# EasyEDA Pro project Chessboards.epro, board PCB6
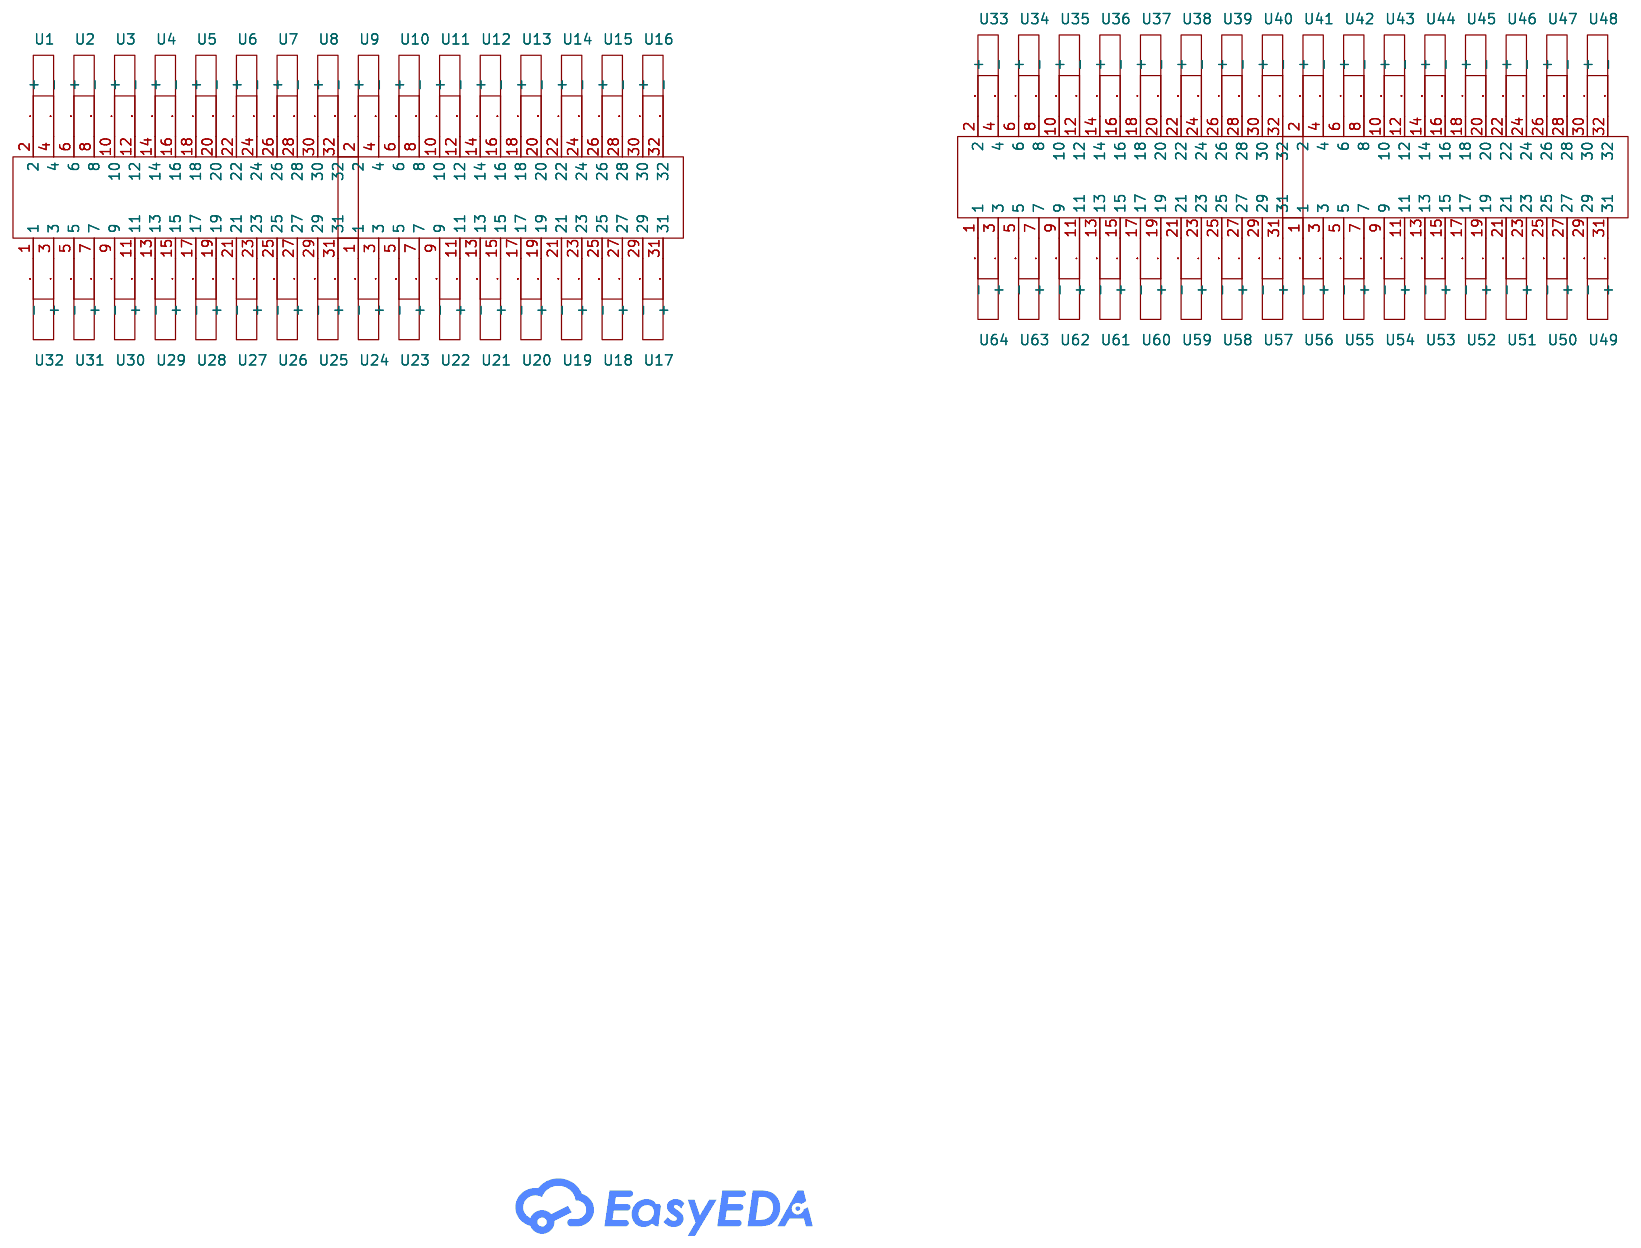
[diagram p0: schematic sheet]

No outline. copper layers: Top Layer, Inner1, Inner2, Inner3, Inner4, Bottom Layer. Coordinates in mm from the lowest, leftmost part position.
Stack: Top Layer 0.035mm Outer layer thickness 1oz / Dielectric1 0.0994mm 3313 RC57% 4.2mil / Inner1 0.0152mm Inner layer thickness / Dielectric2 0.55mm 0.55mm H/H No copper / Inner2 0.0152mm Inner layer thickness / Dielectric3 0.1088mm 2116 RC54% 4.9mil / Inner3 0.0152mm Inner layer thickness / Dielectric4 0.55mm 0.55mm H/H No copper / Inner4 0.0152mm Inner layer thickness / Dielectric5 0.0994mm 3313 RC57% 4.2mil / Bottom Layer 0.035mm Outer layer thickness 1oz

## Design rules (mm)
template: Custom Config
spacing copperThickness1oz (default): track to track 0.102, other pairs 0 to 0.3
spacing copperThickness2oz: track to track 0.203, other pairs 0.152 to 0.3
track width copperThickness1oz (default): min 0.127, default 0.165, max 2.54
track width copperThickness2oz: min 0.127, default 0.165, max 2.54
differential pair differentialPair (default): width min 0.127, default 0.254, max 2.54; gap min 0.152, default 0.152
via viaSize (default): diameter min 0.5, default 0.61, max 10; hole min 0.3, default 0.305, max 6.3

## Placement (name value [footprint] x y rotation side)
H2  BX-PZ1.0-2-16PZZ  [HDR-TH_32P-P1.00-V-M-R2-C16-S1.00]  0 93.01 90 bottom
H3  BX-PZ1.0-2-16PZZ  [HDR-TH_32P-P1.00-V-M-R2-C16-S1.00]  0 132.27 90 bottom
H4  BX-PZ1.0-2-16PZZ  [HDR-TH_32P-P1.00-V-M-R2-C16-S1.00]  0 14.2 90 bottom
H5  BX-PZ1.0-2-16PZZ  [HDR-TH_32P-P1.00-V-M-R2-C16-S1.00]  0 53.61 90 bottom
U1  -  [coil2]  29.62 78.82 0 top
U2  -  [coil2]  49.33 78.82 0 top
U3  -  [coil2]  69.05 78.82 0 top
U4  -  [coil2]  88.77 78.82 0 top
U5  -  [coil2]  108.49 78.82 0 top
U6  -  [coil2]  128.21 78.82 0 top
U7  -  [coil2]  147.93 78.82 0 top
U8  -  [coil2]  167.64 78.82 0 top
U9  -  [coil2]  29.62 118.05 0 top
U10  -  [coil2]  49.33 118.05 0 top
U11  -  [coil2]  69.05 118.05 0 top
U12  -  [coil2]  88.77 118.05 0 top
U13  -  [coil2]  108.49 118.05 0 top
U14  -  [coil2]  128.21 118.05 0 top
U15  -  [coil2]  147.93 118.05 0 top
U16  -  [coil2]  167.64 118.05 0 top
U17  -  [coil2]  29.62 137.78 0 top
U18  -  [coil2]  49.33 137.78 0 top
U19  -  [coil2]  69.05 137.78 0 top
U20  -  [coil2]  88.77 137.78 0 top
U21  -  [coil2]  108.49 137.78 0 top
U22  -  [coil2]  128.21 137.78 0 top
U23  -  [coil2]  147.93 137.78 0 top
U24  -  [coil2]  167.64 137.78 0 top
U25  -  [coil2]  29.62 98.52 0 top
U26  -  [coil2]  49.33 98.52 0 top
U27  -  [coil2]  69.05 98.52 0 top
U28  -  [coil2]  88.77 98.52 0 top
U29  -  [coil2]  108.49 98.52 0 top
U30  -  [coil2]  128.21 98.52 0 top
U31  -  [coil2]  147.93 98.52 0 top
U32  -  [coil2]  167.64 98.52 0 top
U33  -  [coil2]  29.62 0 0 top
U34  -  [coil2]  49.33 0 0 top
U35  -  [coil2]  69.05 0 0 top
U36  -  [coil2]  88.77 0 0 top
U37  -  [coil2]  108.49 0 0 top
U38  -  [coil2]  128.21 0 0 top
U39  -  [coil2]  147.93 0 0 top
U40  -  [coil2]  167.64 0 0 top
U41  -  [coil2]  29.62 39.41 0 top
U42  -  [coil2]  49.33 39.41 0 top
U43  -  [coil2]  69.05 39.41 0 top
U44  -  [coil2]  88.77 39.41 0 top
U45  -  [coil2]  108.49 39.41 0 top
U46  -  [coil2]  128.21 39.41 0 top
U47  -  [coil2]  147.93 39.41 0 top
U48  -  [coil2]  167.64 39.41 0 top
U49  -  [coil2]  29.62 59.11 0 top
U50  -  [coil2]  49.33 59.11 0 top
U51  -  [coil2]  69.05 59.11 0 top
U52  -  [coil2]  88.77 59.11 0 top
U53  -  [coil2]  108.49 59.11 0 top
U54  -  [coil2]  128.21 59.11 0 top
U55  -  [coil2]  147.93 59.11 0 top
U56  -  [coil2]  167.64 59.11 0 top
U57  -  [coil2]  29.62 19.7 0 top
U58  -  [coil2]  49.33 19.7 0 top
U59  -  [coil2]  69.05 19.7 0 top
U60  -  [coil2]  88.77 19.7 0 top
U61  -  [coil2]  108.49 19.7 0 top
U62  -  [coil2]  128.21 19.7 0 top
U63  -  [coil2]  147.93 19.7 0 top
U64  -  [coil2]  167.64 19.7 0 top

## Footprints (pads in the part's own frame, mm; a bottom-side part is the same pattern mirrored in y, then rotated)
coil2
  custom 0x0 smd: 1(-8.716,9.355)
  custom 0x0 smd far side: 2(-9.217,8.956)
HDR-TH_32P-P1.00-V-M-R2-C16-S1.00
  rect 0.8x0.8 hole 0.5: 1(-7.5,-0.5)
  round 0.8 hole 0.5: 2(-7.5,0.5) 3(-6.5,-0.5) 4(-6.5,0.5) 5(-5.5,-0.5) 6(-5.5,0.5) 7(-4.5,-0.5) 8(-4.5,0.5) 9(-3.5,-0.5) 10(-3.5,0.5) 11(-2.5,-0.5) 12(-2.5,0.5) 13(-1.5,-0.5) 14(-1.5,0.5) 15(-0.5,-0.5) 16(-0.5,0.5) 17(0.5,-0.5) 18(0.5,0.5) 19(1.5,-0.5) 20(1.5,0.5) 21(2.5,-0.5) 22(2.5,0.5) 23(3.5,-0.5) 24(3.5,0.5) 25(4.5,-0.5) 26(4.5,0.5) 27(5.5,-0.5) 28(5.5,0.5) 29(6.5,-0.5) 30(6.5,0.5) 31(7.5,-0.5) 32(7.5,0.5)

## Nets
As in the schematic.

## Via types
v1: diameter 0.61, hole 0.305, Top Layer to Bottom Layer, 92 vias

## Routing (per net, layer and track width the routed paths; a pad name or vN(x,y) marks a point on that pad's centre or on a via; arc(x,y) is an arc through that point)
$1N10438: length 22.8
  Top Layer w0.165: 20.83,88.16 20.67,88.32 19.63,88.32 18.92,87.6 v1(18.92,85.57)
  Bottom Layer w0.165: v1(18.92,85.57) 18.86,85.51 0.47,85.51
$1N10440: length 20.7
  Bottom Layer w0.165: 0.47,86.51 18.98,86.51 19.56,87.1 19.56,87.5 19.81,87.76 20.42,87.76
$1N10442: length 43.1
  Top Layer w0.165: 40.59,88.17 39.61,88.17 39.24,87.8 v1(39.24,86.83)
  Bottom Layer w0.165: v1(39.24,86.83) 39.24,87.73 38.41,88.55 22.5,88.55 22.24,88.81 18.09,88.81 16.8,87.51 0.47,87.51
$1N10444: length 40.8
  Bottom Layer w0.165: 40.09,87.77 38.79,89.08 16.21,89.08 15.19,88.05 0.93,88.05 0.47,88.51
$1N10446: length 62.7
  Top Layer w0.165: v1(58.71,86.55) 58.71,87.35 59.53,88.17 60.31,88.17
  Bottom Layer w0.165: v1(58.71,86.55) 58.71,87.38 57.77,88.33 42.49,88.33 41.47,89.34 0.65,89.34 0.47,89.51
$1N10448: length 60.5
  Bottom Layer w0.165: 0.47,90.51 1.38,89.61 41.91,89.61 42.92,88.59 58.99,88.59 59.81,87.77
$1N10450: length 80.9
  Top Layer w0.165: 80.03,88.17 78.67,88.17 77.99,88.85 4.81,88.85 2.15,91.51 0.47,91.51
$1N10452: length 81
  Bottom Layer w0.165: 0.47,92.51 1.99,91 15.64,91 16.76,89.88 42.02,89.88 42.27,89.63 77.67,89.63 79.53,87.77
$1N10454: length 105.1
  Top Layer w0.165: v1(98.62,86.78) 98.62,87.4 99.39,88.17 99.75,88.17
  Inner1 w0.165: v1(98.62,86.78) 98.62,87.53 97.83,88.32 81.97,88.32 81.39,88.89 78.94,88.89 78.31,88.27 61.92,88.27 61.31,88.88 59.44,88.88 58.74,88.18 42.74,88.18 41.99,88.93 40.61,88.93 39.99,88.3 22.36,88.3 21.79,88.88 19.11,88.88 14.47,93.51 0.47,93.51
$1N10456: length 103.9
  Inner2 w0.165: 0.47,94.51 1.01,93.98 13.94,93.98 19.06,88.85 21.94,88.85 22.44,88.35 40.14,88.35 40.64,88.85 41.99,88.85 42.71,88.13 58.69,88.13 58.86,88.3 58.86,88.3 59.44,88.88 61.36,88.88 61.99,88.25 79.17,88.25 79.97,89.06 81.21,89.06 81.95,88.32 97.18,88.32 97.84,87.65 v1(97.84,87.3)
  Bottom Layer w0.165: 99.25,87.77 98.31,87.77 v1(97.84,87.3)
$1N10458: length 124.6
  Top Layer w0.165: v1(117.54,86.78) 117.54,87.53 118.19,88.17 119.47,88.17
  Inner2 w0.165: v1(117.54,86.78) 117.54,87.85 117.24,88.15 101.72,88.15 100.86,89.01 99.02,89.01 98.6,88.58 82.06,88.58 81.32,89.33 19.08,89.33 13.13,95.28 0.71,95.28 0.47,95.51
$1N10460: length 125
  Inner1 w0.165: v1(118.34,86.5) 118.27,86.58 118.27,87.58 117.69,88.15 101.67,88.15 100.86,88.96 99,88.96 98.62,88.58 82.08,88.58 81.51,89.16 78.83,89.16 78.2,88.53 62.03,88.53 61.37,89.19 19.17,89.19 11.85,96.51 0.47,96.51
  Bottom Layer w0.165: 118.96,87.77 118.8,87.61 118.79,87.61 118.5,87.32 118.5,87.31 118.34,87.15 v1(118.34,86.5)
$1N10462: length 146.1
  Top Layer w0.165: v1(137.42,86.25) 137.42,87.65 137.94,88.17 139.18,88.17
  Inner2 w0.165: 0.47,97.51 11.27,97.51 19.2,89.59 81.45,89.59 82.19,88.85 98.35,88.85 98.77,89.28 116.65,89.28 117,88.93 120.57,88.93 121.49,88 137.02,88 137.42,87.6 v1(137.42,86.25)
$1N10464: length 147.2
  Inner1 w0.165: v1(138.19,86.08) 138.07,86.2 138.07,87.84 137.9,88 121.44,88 120.54,88.9 117.99,88.9 117.5,88.42 102.05,88.42 101.24,89.23 98.83,89.23 98.46,88.85 82.19,88.85 81.62,89.43 78.72,89.43 78.09,88.8 62.14,88.8 61.48,89.46 19.28,89.46 11.96,96.78 3.26,96.78 1.53,98.51 0.47,98.51
  Bottom Layer w0.165: v1(138.19,86.08) 138.07,86.2 138.07,87.38 138.46,87.77 138.68,87.77
$1N10466: length 165.8
  Top Layer w0.165: 158.9,88.17 157.64,88.17 157.04,87.58 v1(157.04,86.8)
  Inner2 w0.165: v1(157.04,86.8) 157.04,88.73 155.91,89.86 19.31,89.86 9.65,99.51 0.47,99.51
$1N10468: length 166.3
  Inner1 w0.165: 0.47,100.51 H2.32 3.76,97.25 11.86,97.25 19.39,89.73 138.54,89.73 139.14,89.13 156.59,89.13 157.89,87.83 v1(157.89,86.18)
  Bottom Layer w0.165: 158.4,87.77 158.14,87.77 157.89,87.53 v1(157.89,86.18)
$1N10470: length 28.3
  Top Layer w0.165: 20.85,107.9 20.73,108.03 19.81,108.03 19.02,107.24 v1(19.02,101.75)
  Bottom Layer w0.165: -0.53,100.51 -0.51,100.53 -0.51,101.5 -0.39,101.62 18.89,101.62 v1(19.02,101.75)
$1N10472: length 29.6
  Top Layer w0.165: v1(18.41,107.47) 18.41,102.46 v1(18.39,102.44)
  Bottom Layer w0.165: -0.53,99.51 -0.64,99.63 -1.1,99.63 -1.22,99.75 -1.22,101.55 -0.33,102.44 v1(18.39,102.44) ; v1(18.41,107.47) 18.42,107.48 U25.2 20.42,107.48
$1N10474: length 54.1
  Top Layer w0.165: 40.59,107.88 39.71,107.88 38.71,106.88 v1(38.71,105.9)
  Bottom Layer w0.165: -0.53,98.51 -1.59,99.58 -1.59,101.9 -0.31,103.18 16.89,103.18 17.79,104.08 17.79,107.65 18.62,108.48 22.34,108.48 22.92,107.9 38.04,107.9 38.71,107.23 v1(38.71,105.9)
$1N10476: length 52.4
  Bottom Layer w0.165: 40.09,107.48 39.4,108.17 23.03,108.17 22.45,108.75 18.51,108.75 17.52,107.76 17.52,104.19 16.78,103.44 -0.42,103.44 -1.86,102.01 -1.86,98.84 -0.53,97.51
$1N10478: length 74.1
  Top Layer w0.165: 60.31,107.88 59.44,107.88 58.77,107.2 v1(58.77,106.38)
  Bottom Layer w0.165: v1(58.77,106.38) 58.77,107 57.33,108.44 23.14,108.44 22.56,109.02 4.77,109.02 -2.12,102.12 -2.12,98.11 -0.53,96.51
$1N10480: length 73.4
  Bottom Layer w0.165: -0.53,95.51 -2.39,97.38 -2.39,102.23 4.66,109.29 22.67,109.29 23.25,108.7 58.58,108.7 59.81,107.48
$1N10482: length 95.3
  Top Layer w0.165: v1(78.49,108.02) 79.03,108.02 79.24,108.23 79.68,108.23 80.03,107.88
  Bottom Layer w0.165: -0.53,94.51 -2.66,96.65 -2.66,102.35 4.55,109.55 22.78,109.55 23.36,108.97 77.54,108.97 v1(78.49,108.02)
$1N10484: length 94.6
  Inner1 w0.165: -0.53,93.51 -0.86,93.51 -1.65,94.3 -1.65,101.46 5.43,108.54 77.43,108.54 77.89,108.09 77.89,106.98 v1(78.29,106.58)
  Bottom Layer w0.165: v1(78.29,106.58) 79.19,107.48 79.53,107.48
$1N10486: length 117.6
  Top Layer w0.165: 99.75,107.88 99.46,108.16 99.03,108.16 98.65,107.78 98.65,106.13 98.27,105.75 97.79,105.75 97.57,105.98 97.57,107.83 96.83,108.56 5.62,108.56 -1.24,101.7 -1.24,93.23 -0.53,92.51
$1N10488: length 116.7
  Top Layer w0.165: v1(98.11,106.48) 98.11,107.66 96.94,108.83 5.51,108.83 -1.5,101.81 -1.5,92.6 -0.53,91.62 -0.53,91.51
  Bottom Layer w0.165: 99.25,107.48 98.62,107.48 98.11,106.97 v1(98.11,106.48)
$1N10490: length 140.7
  Top Layer w0.165: 119.47,107.88 119.31,108.03 118.84,108.03 118.41,107.6 118.41,105.87 118.24,105.7 117.64,105.7 117.33,106.01 117.33,107.91 116.15,109.09 5.4,109.09 -1.77,101.92 -1.77,91.76 -0.53,90.51
$1N10492: length 139.8
  Top Layer w0.165: v1(117.87,106.57) 117.87,107.75 116.26,109.36 5.29,109.36 -2.04,102.03 -2.04,91.03 -0.53,89.51
  Bottom Layer w0.165: 118.96,107.48 118.54,107.48 117.69,106.63 117.82,106.63 v1(117.87,106.57)
$1N10494: length 159.7
  Top Layer w0.165: 139.18,107.88 138.71,108.35 136.64,108.35 135.37,109.63 5.18,109.63 -2.31,102.15 -2.31,91.81 -2.31,91.8 -2.31,90.3 -0.53,88.51
$1N10496: length 158.8
  Inner1 w0.165: -0.53,87.51 -1.91,88.9 -1.91,101.57 5.32,108.81 136.56,108.81 v1(137.71,107.66)
  Bottom Layer w0.165: v1(137.71,107.66) 138.5,107.66 138.68,107.48
$1N10498: length 180.5
  Top Layer w0.165: 158.9,107.88 158.65,108.13 v1(155.42,108.13)
  Inner1 w0.165: -0.53,86.51 -2.18,88.17 -2.18,101.69 5.21,109.08 139.89,109.08 140.84,108.13 v1(155.42,108.13)
$1N10500: length 182.1
  Inner1 w0.165: v1(157.19,108.73) 156.54,109.38 4.79,109.38 -2.45,102.14 -2.45,87.44 -0.53,85.51
  Bottom Layer w0.165: v1(157.19,108.73) 158.4,107.52 158.4,107.48
$1N10638: length 22.8
  Top Layer w0.165: 20.83,127.42 20.67,127.57 19.63,127.57 18.92,126.86 v1(18.92,124.83)
  Bottom Layer w0.165: 0.47,124.77 18.86,124.77 v1(18.92,124.83)
$1N10640: length 20.7
  Bottom Layer w0.165: 0.47,125.77 18.98,125.77 19.56,126.35 19.56,126.76 19.81,127.01 20.42,127.01
$1N10642: length 43.1
  Top Layer w0.165: 40.59,127.43 39.61,127.43 39.24,127.06 v1(39.24,126.08)
  Bottom Layer w0.165: v1(39.24,126.08) 39.24,126.98 38.41,127.81 22.5,127.81 22.24,128.06 18.09,128.06 16.8,126.77 0.47,126.77
$1N10644: length 40.8
  Bottom Layer w0.165: 0.47,127.77 0.93,127.31 15.19,127.31 16.21,128.33 38.79,128.33 40.09,127.03
$1N10646: length 62.7
  Top Layer w0.165: 60.31,127.43 59.53,127.43 58.71,126.61 v1(58.71,125.81)
  Bottom Layer w0.165: v1(58.71,125.81) 58.71,126.63 57.77,127.58 42.49,127.58 41.47,128.6 0.65,128.6 0.47,128.77
$1N10648: length 60.5
  Bottom Layer w0.165: 59.81,127.03 58.99,127.85 42.92,127.85 41.91,128.87 1.38,128.87 0.47,129.77
$1N10650: length 80.9
  Top Layer w0.165: 0.47,130.77 2.15,130.77 4.81,128.11 77.99,128.11 78.67,127.43 80.03,127.43
$1N10652: length 81
  Bottom Layer w0.165: 79.53,127.03 77.67,128.88 42.27,128.88 42.02,129.13 16.76,129.13 15.64,130.26 1.99,130.26 0.47,131.77
$1N10654: length 105.1
  Top Layer w0.165: v1(98.62,126.03) 98.62,126.66 99.39,127.43 99.75,127.43
  Inner1 w0.165: 0.47,132.77 14.47,132.77 19.11,128.13 21.79,128.13 22.36,127.56 39.99,127.56 40.61,128.18 41.99,128.18 42.74,127.43 58.74,127.43 59.44,128.13 61.31,128.13 61.92,127.52 78.31,127.52 78.94,128.15 81.39,128.15 81.97,127.57 97.83,127.57 98.62,126.78 v1(98.62,126.03)
$1N10656: length 103.9
  Inner2 w0.165: v1(97.84,126.56) 97.84,126.91 97.18,127.57 81.95,127.57 81.21,128.31 79.97,128.31 79.17,127.51 61.99,127.51 61.36,128.13 59.44,128.13 58.86,127.55 58.86,127.55 58.69,127.39 42.71,127.39 41.99,128.11 40.64,128.11 40.14,127.61 22.44,127.61 21.94,128.11 19.06,128.11 13.94,133.23 1.01,133.23 0.47,133.77
  Bottom Layer w0.165: v1(97.84,126.56) 98.31,127.03 99.25,127.03
$1N10658: length 124.6
  Top Layer w0.165: v1(117.54,126.03) 117.54,126.78 118.19,127.43 119.47,127.43
  Inner2 w0.165: v1(117.54,126.03) 117.54,127.11 117.24,127.41 101.72,127.41 100.86,128.27 99.02,128.27 98.6,127.84 82.06,127.84 81.32,128.58 19.08,128.58 13.13,134.53 0.71,134.53 0.47,134.77
$1N10660: length 125
  Inner1 w0.165: 0.47,135.77 11.85,135.77 19.17,128.45 61.37,128.45 62.03,127.79 78.2,127.79 78.83,128.42 81.51,128.42 82.08,127.84 98.62,127.84 99,128.22 100.86,128.22 101.67,127.41 117.69,127.41 118.27,126.83 118.27,125.83 v1(118.34,125.76)
  Bottom Layer w0.165: v1(118.34,125.76) 118.34,126.41 118.5,126.57 118.5,126.58 118.79,126.87 118.8,126.87 118.96,127.03
$1N10662: length 146.1
  Top Layer w0.165: 139.18,127.43 137.94,127.43 137.42,126.91 v1(137.42,125.51)
  Inner2 w0.165: 0.47,136.77 11.27,136.77 19.2,128.85 81.45,128.85 82.19,128.11 98.35,128.11 98.77,128.53 116.65,128.53 117,128.18 120.57,128.18 121.49,127.26 137.02,127.26 137.42,126.86 v1(137.42,125.51)
$1N10664: length 147.2
  Inner1 w0.165: v1(138.19,125.33) 138.07,125.46 138.07,127.09 137.9,127.26 121.44,127.26 120.54,128.16 117.99,128.16 117.5,127.67 102.05,127.67 101.24,128.48 98.83,128.48 98.46,128.11 82.19,128.11 81.62,128.68 78.72,128.68 78.09,128.06 62.14,128.06 61.48,128.72 19.28,128.72 11.96,136.04 3.26,136.04 1.53,137.77 0.47,137.77
  Bottom Layer w0.165: v1(138.19,125.33) 138.07,125.46 138.07,126.63 138.46,127.03 138.68,127.03
$1N10666: length 165.8
  Top Layer w0.165: 158.9,127.43 157.64,127.43 157.04,126.83 v1(157.04,126.06)
  Inner2 w0.165: v1(157.04,126.06) 157.04,127.98 155.91,129.12 19.31,129.12 9.65,138.77 0.47,138.77
$1N10668: length 166.3
  Inner1 w0.165: 0.47,139.77 H3.32 3.76,136.51 11.86,136.51 19.39,128.98 138.54,128.98 139.14,128.38 156.59,128.38 157.89,127.08 v1(157.89,125.43)
  Bottom Layer w0.165: 158.4,127.03 158.14,127.03 157.89,126.78 v1(157.89,125.43)
$1N10670: length 28.3
  Top Layer w0.165: v1(19.02,141.01) 19.02,146.49 19.81,147.28 20.73,147.28 20.85,147.15
  Bottom Layer w0.165: v1(19.02,141.01) 18.89,140.87 -0.39,140.87 -0.51,140.75 -0.51,139.79 -0.53,139.77
$1N10672: length 29.6
  Top Layer w0.165: v1(18.39,141.69) 18.41,141.72 v1(18.41,146.72)
  Bottom Layer w0.165: v1(18.41,146.72) 18.42,146.73 20.37,146.73 ; v1(18.39,141.69) -0.33,141.69 -1.22,140.81 -1.22,139 -1.1,138.88 -0.64,138.88 -0.53,138.77
$1N10674: length 54.1
  Top Layer w0.165: 40.59,147.13 39.71,147.13 38.71,146.13 v1(38.71,145.16)
  Bottom Layer w0.165: v1(38.71,145.16) 38.71,146.48 38.04,147.16 22.92,147.16 22.34,147.74 18.62,147.74 17.79,146.91 17.79,143.33 16.89,142.43 -0.31,142.43 -1.59,141.16 -1.59,138.83 -0.53,137.77
$1N10676: length 52.4
  Bottom Layer w0.165: -0.53,136.77 -1.86,138.1 -1.86,141.27 -0.42,142.7 16.78,142.7 17.52,143.44 17.52,147.02 18.51,148.01 22.45,148.01 23.03,147.43 39.4,147.43 40.09,146.73
$1N10678: length 74.1
  Top Layer w0.165: v1(58.77,145.63) 58.77,146.46 59.44,147.13 60.31,147.13
  Bottom Layer w0.165: -0.53,135.77 -2.12,137.37 -2.12,141.38 4.77,148.27 22.56,148.27 23.14,147.69 57.33,147.69 58.77,146.26 v1(58.77,145.63)
$1N10680: length 73.4
  Bottom Layer w0.165: -0.53,134.77 -2.39,136.63 -2.39,141.49 4.66,148.54 22.67,148.54 23.25,147.96 58.58,147.96 59.81,146.73
$1N10682: length 95.3
  Top Layer w0.165: 80.03,147.13 79.68,147.48 79.24,147.48 79.03,147.28 v1(78.49,147.28)
  Bottom Layer w0.165: -0.53,133.77 -2.66,135.9 -2.66,141.6 4.55,148.81 22.78,148.81 23.36,148.23 77.54,148.23 v1(78.49,147.28)
$1N10684: length 94.6
  Inner1 w0.165: v1(78.29,145.83) 77.89,146.23 77.89,147.34 77.43,147.8 5.43,147.8 -1.65,140.72 -1.65,133.56 -0.86,132.77 -0.53,132.77
  Bottom Layer w0.165: 79.53,146.73 79.19,146.73 v1(78.29,145.83)
$1N10686: length 117.6
  Top Layer w0.165: 99.75,147.13 99.46,147.42 99.03,147.42 98.65,147.04 98.65,145.39 98.27,145.01 97.79,145.01 97.57,145.23 97.57,147.08 96.83,147.82 5.62,147.82 -1.24,140.96 -1.24,132.48 -0.53,131.77
$1N10688: length 116.7
  Top Layer w0.165: v1(98.11,145.73) 98.11,146.92 96.94,148.08 5.51,148.08 -1.5,141.07 -1.5,131.85 -0.53,130.87 -0.53,130.77
  Bottom Layer w0.165: 99.25,146.73 98.62,146.73 98.11,146.22 v1(98.11,145.73)
$1N10690: length 140.7
  Top Layer w0.165: -0.53,129.77 -1.77,131.02 -1.77,141.18 5.4,148.35 116.15,148.35 117.33,147.17 117.33,145.27 117.64,144.96 118.24,144.96 118.41,145.13 118.41,146.85 118.84,147.28 119.31,147.28 119.47,147.13
$1N10692: length 139.8
  Top Layer w0.165: -0.53,128.77 -2.04,130.28 -2.04,141.29 5.29,148.62 116.26,148.62 117.87,147.01 v1(117.87,145.83)
  Bottom Layer w0.165: 118.96,146.73 118.54,146.73 117.69,145.88 117.82,145.88 v1(117.87,145.83)
$1N10694: length 159.7
  Top Layer w0.165: 139.18,147.13 138.71,147.61 136.64,147.61 135.37,148.88 5.18,148.88 -2.31,141.4 -2.31,131.06 -2.31,131.06 -2.31,129.56 -0.53,127.77
$1N10696: length 158.8
  Inner1 w0.165: v1(137.71,146.92) 136.56,148.07 5.32,148.07 -1.91,140.83 -1.91,128.16 -0.53,126.77
  Bottom Layer w0.165: 138.68,146.73 138.5,146.92 v1(137.71,146.92)
$1N10698: length 180.5
  Top Layer w0.165: 158.9,147.13 158.65,147.38 v1(155.42,147.38)
  Inner1 w0.165: -0.53,125.77 -2.18,127.42 -2.18,140.94 5.21,148.33 139.89,148.33 140.84,147.38 v1(155.42,147.38)
$1N10700: length 182.1
  Inner1 w0.165: v1(157.19,147.98) 156.54,148.63 4.79,148.63 -2.45,141.4 -2.45,126.69 -0.53,124.77
  Bottom Layer w0.165: v1(157.19,147.98) 158.4,146.78 158.4,146.73
$1N10974: length 22.8
  Top Layer w0.165: 20.85,9.35 20.7,9.5 19.66,9.5 18.95,8.79 v1(18.95,6.76)
  Bottom Layer w0.165: v1(18.95,6.76) 18.89,6.7 H4.2
$1N10976: length 20.7
  Bottom Layer w0.165: 20.45,8.94 19.84,8.94 19.58,8.69 19.58,8.28 19,7.7 H4.4
$1N10978: length 43.1
  Top Layer w0.165: v1(39.27,8.01) 39.27,8.99 39.63,9.36 U34.1
  Bottom Layer w0.165: v1(39.27,8.01) 39.27,8.91 38.44,9.74 22.52,9.74 22.27,9.99 18.12,9.99 16.83,8.7 H4.6
$1N10980: length 40.8
  Bottom Layer w0.165: H4.8 0.96,9.24 15.22,9.24 16.24,10.26 38.81,10.26 U34.2
$1N10982: length 105.1
  Top Layer w0.165: U37.1 99.41,9.36 98.64,8.59 v1(98.64,7.96)
  Inner1 w0.165: H4.18 14.49,14.7 19.13,10.06 21.81,10.06 22.39,9.49 40.02,9.49 40.64,10.11 42.02,10.11 42.77,9.36 58.76,9.36 59.46,10.06 61.34,10.06 61.95,9.45 78.34,9.45 78.96,10.08 81.42,10.08 82,9.5 97.85,9.5 98.64,8.71 v1(98.64,7.96)
$1N10984: length 103.9
  Inner2 w0.165: H4.20 1.04,15.16 13.96,15.16 19.09,10.04 21.96,10.04 22.46,9.54 40.17,9.54 40.67,10.04 42.02,10.04 42.74,9.32 58.72,9.32 58.88,9.48 58.89,9.48 59.47,10.06 61.39,10.06 62.02,9.44 79.19,9.44 80,10.24 81.23,10.24 81.97,9.5 97.2,9.5 97.87,8.84 v1(97.87,8.49)
  Bottom Layer w0.165: v1(97.87,8.49) 98.34,8.96 U37.2
$1N10986: length 43.1
  Top Layer w0.165: v1(39.24,47.42) 39.24,48.39 39.61,48.76 40.59,48.76
  Bottom Layer w0.165: v1(39.24,47.42) 39.24,48.32 38.41,49.14 22.5,49.14 22.24,49.4 18.09,49.4 16.8,48.11 0.47,48.11
$1N10988: length 40.8
  Bottom Layer w0.165: 40.09,48.36 38.79,49.67 16.21,49.67 15.19,48.65 0.93,48.65 0.47,49.11
$1N10990: length 62.7
  Top Layer w0.165: 60.31,48.76 59.53,48.76 58.71,47.94 v1(58.71,47.14)
  Bottom Layer w0.165: 0.47,50.11 0.65,49.94 41.47,49.94 42.49,48.92 57.77,48.92 58.71,47.97 v1(58.71,47.14)
$1N10992: length 60.5
  Bottom Layer w0.165: 59.81,48.36 58.99,49.19 42.92,49.19 41.91,50.2 1.38,50.2 0.47,51.11
$1N10994: length 124.6
  Top Layer w0.165: 119.47,48.76 118.19,48.76 117.54,48.12 v1(117.54,47.37)
  Inner2 w0.165: v1(117.54,47.37) 117.54,48.44 117.24,48.74 101.72,48.74 100.86,49.6 99.02,49.6 98.6,49.18 82.06,49.18 81.32,49.92 19.08,49.92 13.13,55.87 0.71,55.87 0.47,56.11
$1N10996: length 125
  Inner1 w0.165: 0.47,57.11 11.85,57.11 19.17,49.79 61.37,49.79 62.03,49.13 78.2,49.13 78.83,49.75 81.51,49.75 82.08,49.18 98.62,49.18 99,49.55 100.86,49.55 101.67,48.74 117.69,48.74 118.27,48.17 118.27,47.17 v1(118.34,47.09)
  Bottom Layer w0.165: v1(118.34,47.09) 118.34,47.74 118.5,47.9 118.5,47.91 118.79,48.2 118.8,48.2 118.96,48.36
$1N10998: length 80.9
  Top Layer w0.165: 0.47,52.11 2.15,52.11 4.81,49.44 77.99,49.44 78.67,48.76 80.03,48.76
$1N11000: length 81
  Bottom Layer w0.165: 79.53,48.36 77.67,50.22 42.27,50.22 42.02,50.47 16.76,50.47 15.64,51.59 1.99,51.59 0.47,53.11
$1N11002: length 105.1
  Top Layer w0.165: v1(98.62,47.37) 98.62,47.99 99.39,48.76 99.75,48.76
  Inner1 w0.165: v1(98.62,47.37) 98.62,48.12 97.83,48.91 81.97,48.91 81.39,49.48 78.94,49.48 78.31,48.86 61.92,48.86 61.31,49.47 59.44,49.47 58.74,48.77 42.74,48.77 41.99,49.52 40.61,49.52 39.99,48.89 22.36,48.89 21.79,49.47 19.11,49.47 14.47,54.11 0.47,54.11
$1N11004: length 103.9
  Inner2 w0.165: 0.47,55.11 1.01,54.57 13.94,54.57 19.06,49.44 21.94,49.44 22.44,48.94 40.14,48.94 40.64,49.44 41.99,49.44 42.71,48.72 58.69,48.72 58.86,48.89 58.86,48.89 59.44,49.47 61.36,49.47 61.99,48.84 79.17,48.84 79.97,49.65 81.21,49.65 81.95,48.91 97.18,48.91 97.84,48.24 v1(97.84,47.89)
  Bottom Layer w0.165: v1(97.84,47.89) 98.31,48.36 99.25,48.36
$1N11006: length 165.8
  Top Layer w0.165: v1(157.07,7.99) 157.07,8.76 157.66,9.36 U40.1
  Inner2 w0.165: H4.30 9.68,20.7 19.33,11.04 155.94,11.04 157.07,9.91 v1(157.07,7.99)
$1N11008: length 166.3
  Inner1 w0.165: v1(157.92,7.36) 157.92,9.01 156.62,10.31 139.17,10.31 138.57,10.91 19.41,10.91 11.89,18.44 3.79,18.44 0.53,21.7 H4.32
  Bottom Layer w0.165: U40.2 158.17,8.96 157.92,8.71 v1(157.92,7.36)
$1N11010: length 22.8
  Top Layer w0.165: v1(18.92,46.16) 18.92,48.2 19.63,48.91 20.67,48.91 20.83,48.76
  Bottom Layer w0.165: 0.47,46.11 18.86,46.11 v1(18.92,46.16)
$1N11012: length 20.7
  Bottom Layer w0.165: 0.47,47.11 18.98,47.11 19.56,47.69 19.56,48.09 19.81,48.35 20.42,48.35
$1N11014: length 62.7
  Top Layer w0.165: U35.1 59.56,9.36 58.74,8.54 v1(58.74,7.74)
  Bottom Layer w0.165: H4.10 0.67,10.53 41.5,10.53 42.52,9.51 57.79,9.51 58.74,8.56 v1(58.74,7.74)
$1N11016: length 60.5
  Bottom Layer w0.165: U35.2 59.01,9.78 42.95,9.78 41.93,10.79 1.4,10.79 H4.12
$1N11018: length 80.9
  Top Layer w0.165: U36.1 78.7,9.36 78.02,10.04 4.84,10.04 2.18,12.7 H4.14
$1N11020: length 81
  Bottom Layer w0.165: U36.2 77.7,10.81 42.29,10.81 42.04,11.06 16.79,11.06 15.66,12.19 2.01,12.19 H4.16
$1N11022: length 146.1
  Top Layer w0.165: v1(137.42,46.84) 137.42,48.24 137.94,48.76 139.18,48.76
  Inner2 w0.165: 0.47,58.11 11.27,58.11 19.2,50.18 81.45,50.18 82.19,49.44 98.35,49.44 98.77,49.87 116.65,49.87 117,49.52 120.57,49.52 121.49,48.59 137.02,48.59 137.42,48.19 v1(137.42,46.84)
$1N11024: length 147.2
  Inner1 w0.165: 0.47,59.11 1.53,59.11 3.26,57.37 11.96,57.37 19.28,50.05 61.48,50.05 62.14,49.39 78.09,49.39 78.72,50.02 81.62,50.02 82.19,49.44 98.46,49.44 98.83,49.82 101.24,49.82 102.05,49.01 117.5,49.01 117.99,49.49 120.54,49.49 121.44,48.59 137.9,48.59 138.07,48.43 138.07,46.79 v1(138.19,46.67)
  Bottom Layer w0.165: v1(138.19,46.67) 138.07,46.79 138.07,47.97 138.46,48.36 138.68,48.36
$1N11026: length 165.8
  Top Layer w0.165: v1(157.04,47.39) 157.04,48.17 157.64,48.76 158.9,48.76
  Inner2 w0.165: 0.47,60.11 9.65,60.11 19.31,50.45 155.91,50.45 157.04,49.32 v1(157.04,47.39)
$1N11028: length 166.3
  Inner1 w0.165: 0.47,61.11 H5.32 3.76,57.84 11.86,57.84 19.39,50.32 138.54,50.32 139.14,49.72 156.59,49.72 157.89,48.42 v1(157.89,46.77)
  Bottom Layer w0.165: v1(157.89,46.77) 157.89,48.12 158.14,48.36 158.4,48.36
$1N11030: length 124.6
  Top Layer w0.165: U38.1 118.21,9.36 117.57,8.71 v1(117.57,7.96)
  Inner2 w0.165: v1(117.57,7.96) 117.57,9.04 117.27,9.34 101.74,9.34 100.89,10.19 99.05,10.19 98.63,9.77 82.08,9.77 81.34,10.51 19.11,10.51 13.16,16.46 0.74,16.46 H4.22
$1N11032: length 125
  Inner1 w0.165: v1(118.37,7.69) 118.29,7.76 118.29,8.76 117.72,9.34 101.69,9.34 100.89,10.14 99.03,10.14 98.65,9.77 82.11,9.77 81.53,10.34 78.85,10.34 78.23,9.72 62.06,9.72 61.4,10.38 19.19,10.38 11.87,17.7 H4.24
  Bottom Layer w0.165: v1(118.37,7.69) 118.37,8.33 118.53,8.49 118.53,8.5 118.82,8.79 118.83,8.79 U38.2
$1N11034: length 146.1
  Top Layer w0.165: U39.1 137.96,9.36 137.44,8.84 v1(137.44,7.44)
  Inner2 w0.165: H4.26 11.3,18.7 19.22,10.78 81.48,10.78 82.22,10.04 98.38,10.04 98.8,10.46 116.68,10.46 117.03,10.11 120.59,10.11 121.52,9.19 137.04,9.19 137.44,8.79 v1(137.44,7.44)
$1N11036: length 147.2
  Inner1 w0.165: H4.28 1.55,19.7 3.28,17.97 11.98,17.97 19.3,10.65 61.51,10.65 62.17,9.99 78.12,9.99 78.74,10.61 81.64,10.61 82.22,10.04 98.48,10.04 98.86,10.41 101.27,10.41 102.08,9.6 117.53,9.6 118.01,10.09 120.57,10.09 121.47,9.19 137.93,9.19 138.09,9.02 138.09,7.39 v1(138.22,7.26)
  Bottom Layer w0.165: U39.2 138.49,8.96 138.09,8.56 138.09,7.39 v1(138.22,7.26)
$1N11038: length 180.5
  Top Layer w0.165: v1(155.45,29.31) 158.68,29.31 U64.1
  Inner1 w0.165: v1(155.45,29.31) 140.87,29.31 139.92,30.26 5.24,30.26 -2.15,22.87 -2.15,9.35 H4.3
$1N11040: length 182.1
  Inner1 w0.165: H4.1 -2.42,8.62 -2.42,23.33 4.81,30.56 156.57,30.56 v1(157.22,29.91)
  Bottom Layer w0.165: v1(157.22,29.91) 158.43,28.71 U64.2
$1N11042: length 159.7
  Top Layer w0.165: U63.1 138.73,29.54 136.67,29.54 135.39,30.81 5.2,30.81 -2.28,23.33 -2.28,12.99 -2.29,12.99 -2.29,11.49 H4.7
$1N11044: length 158.8
  Inner1 w0.165: v1(137.74,28.84) 136.59,29.99 5.35,29.99 -1.89,22.76 -1.89,10.09 H4.5
  Bottom Layer w0.165: v1(137.74,28.84) 138.53,28.84 U63.2
$1N11046: length 140.7
  Top Layer w0.165: U62.1 119.34,29.21 118.87,29.21 118.44,28.78 118.44,27.06 118.27,26.89 117.67,26.89 117.36,27.2 117.36,29.1 116.18,30.28 5.42,30.28 -1.75,23.11 -1.75,12.94 H4.11
$1N11048: length 139.8
  Top Layer w0.165: H4.9 -2.01,12.21 -2.01,23.22 5.31,30.54 116.29,30.54 117.9,28.94 v1(117.9,27.76)
  Bottom Layer w0.165: U62.2 118.57,28.66 117.72,27.81 117.84,27.81 v1(117.9,27.76)
$1N11050: length 180.5
  Top Layer w0.165: 158.9,68.47 158.65,68.72 v1(155.42,68.72)
  Inner1 w0.165: -0.53,47.11 -2.18,48.76 -2.18,62.28 5.21,69.67 139.89,69.67 140.84,68.72 v1(155.42,68.72)
$1N11052: length 182.1
  Inner1 w0.165: -0.53,46.11 -2.45,48.03 -2.45,62.74 4.79,69.97 156.54,69.97 v1(157.19,69.32)
  Bottom Layer w0.165: 158.4,68.07 158.4,68.11 v1(157.19,69.32)
$1N11054: length 28.3
  Top Layer w0.165: 20.88,29.08 20.75,29.21 19.84,29.21 19.05,28.42 v1(19.05,22.94)
  Bottom Layer w0.165: v1(19.05,22.94) 18.91,22.8 -0.37,22.8 -0.48,22.68 -0.48,21.72 H4.31
$1N11056: length 29.6
  Top Layer w0.165: v1(18.44,28.65) 18.44,23.65 v1(18.42,23.62)
  Bottom Layer w0.165: U57.2 18.45,28.66 v1(18.44,28.65) ; H4.29 -0.61,20.81 -1.08,20.81 -1.19,20.93 -1.19,22.73 -0.3,23.62 v1(18.42,23.62)
$1N11058: length 117.6
  Top Layer w0.165: H4.15 -1.21,14.41 -1.21,22.89 5.64,29.74 96.86,29.74 97.59,29.01 97.59,27.16 97.82,26.94 98.29,26.94 98.67,27.32 98.67,28.97 99.05,29.35 99.49,29.35 U61.1
$1N11060: length 116.7
  Top Layer w0.165: H4.13 -0.5,12.8 -1.48,13.78 -1.48,23 5.53,30.01 96.97,30.01 98.13,28.85 v1(98.13,27.66)
  Bottom Layer w0.165: v1(98.13,27.66) 98.13,28.15 98.64,28.66 U61.2
$1N11062: length 95.3
  Top Layer w0.165: v1(78.52,29.2) 79.06,29.2 79.27,29.41 79.7,29.41 U60.1
  Bottom Layer w0.165: H4.19 -2.63,17.83 -2.63,23.53 4.58,30.74 22.81,30.74 23.39,30.16 77.57,30.16 v1(78.52,29.2)
$1N11064: length 94.5
  Inner1 w0.165: H4.17 -0.83,14.7 -1.62,15.49 -1.62,22.65 5.46,29.73 77.46,29.73 77.92,29.27 77.92,28.16 v1(78.32,27.76)
  Bottom Layer w0.165: U60.2 79.22,28.66 v1(78.32,27.76)
$1N11066: length 74.1
  Top Layer w0.165: v1(58.79,27.56) 58.79,28.39 59.46,29.06 U59.1
  Bottom Layer w0.165: H4.23 -2.1,19.29 -2.1,23.31 4.8,30.2 22.59,30.2 23.17,29.62 57.36,29.62 58.79,28.19 v1(58.79,27.56)
$1N11068: length 73.4
  Bottom Layer w0.165: U59.2 58.61,29.89 23.28,29.89 22.7,30.47 4.69,30.47 -2.36,23.42 -2.36,18.56 H4.21
$1N11070: length 54.1
  Top Layer w0.165: v1(38.74,27.09) 38.74,28.06 39.74,29.06 U58.1
  Bottom Layer w0.165: v1(38.74,27.09) 38.74,28.41 38.07,29.09 22.95,29.09 22.37,29.67 18.65,29.67 17.81,28.84 17.81,25.26 16.91,24.36 -0.29,24.36 -1.56,23.09 -1.56,20.76 H4.27
$1N11072: length 52.4
  Bottom Layer w0.165: H4.25 -1.83,20.03 -1.83,23.2 -0.4,24.63 16.8,24.63 17.55,25.37 17.55,28.95 18.54,29.94 22.48,29.94 23.06,29.35 39.42,29.35 U58.2
$1N11074: length 117.6
  Top Layer w0.165: 99.75,68.47 99.46,68.75 99.03,68.75 98.65,68.37 98.65,66.72 98.27,66.34 97.79,66.34 97.57,66.57 97.57,68.42 96.83,69.15 5.62,69.15 -1.24,62.29 -1.24,53.82 -0.53,53.11
$1N11076: length 116.7
  Top Layer w0.165: v1(98.11,67.07) 98.11,68.26 96.94,69.42 5.51,69.42 -1.5,62.41 -1.5,53.19 -0.53,52.21 -0.53,52.11
  Bottom Layer w0.165: 99.25,68.07 98.62,68.07 98.11,67.56 v1(98.11,67.07)
$1N11078: length 140.7
  Top Layer w0.165: 119.47,68.47 119.31,68.62 118.84,68.62 118.41,68.19 118.41,66.46 118.24,66.29 117.64,66.29 117.33,66.61 117.33,68.51 116.15,69.69 5.4,69.69 -1.77,62.52 -1.77,52.35 -0.53,51.11
$1N11080: length 139.8
  Top Layer w0.165: -0.53,50.11 -2.04,51.62 -2.04,62.63 5.29,69.95 116.26,69.95 117.87,68.34 v1(117.87,67.17)
  Bottom Layer w0.165: 118.96,68.07 118.54,68.07 117.69,67.22 117.82,67.22 v1(117.87,67.17)
$1N11082: length 159.7
  Top Layer w0.165: 139.18,68.47 138.71,68.94 136.64,68.94 135.37,70.22 5.18,70.22 -2.31,62.74 -2.31,52.4 -2.31,52.39 -2.31,50.89 -0.53,49.11
$1N11084: length 158.8
  Inner1 w0.165: -0.53,48.11 -1.91,49.49 -1.91,62.17 5.32,69.4 136.56,69.4 v1(137.71,68.25)
  Bottom Layer w0.165: 138.68,68.07 138.5,68.25 v1(137.71,68.25)
$1N11086: length 28.3
  Top Layer w0.165: v1(19.02,62.34) 19.02,67.83 19.81,68.62 20.73,68.62 20.85,68.49
  Bottom Layer w0.165: -0.53,61.11 -0.51,61.12 -0.51,62.09 -0.39,62.21 18.89,62.21 v1(19.02,62.34)
$1N11088: length 29.6
  Top Layer w0.165: v1(18.41,68.06) 18.41,63.06 v1(18.39,63.03)
  Bottom Layer w0.165: v1(18.41,68.06) 18.42,68.07 20.37,68.07 ; v1(18.39,63.03) -0.33,63.03 -1.22,62.14 -1.22,60.34 -1.1,60.22 -0.64,60.22 -0.53,60.11
$1N11090: length 95.3
  Top Layer w0.165: v1(78.49,68.61) 79.03,68.61 79.24,68.82 79.68,68.82 80.03,68.47
  Bottom Layer w0.165: v1(78.49,68.61) 77.54,69.56 23.36,69.56 22.78,70.14 4.55,70.14 -2.66,62.94 -2.66,57.24 -0.53,55.11
$1N11092: length 94.6
  Inner1 w0.165: v1(78.29,67.17) 77.89,67.57 77.89,68.68 77.43,69.14 5.43,69.14 -1.65,62.06 -1.65,54.89 -0.86,54.11 -0.53,54.11
  Bottom Layer w0.165: 79.53,68.07 79.19,68.07 v1(78.29,67.17)
$1N11094: length 54.1
  Top Layer w0.165: 40.59,68.47 39.71,68.47 38.71,67.47 v1(38.71,66.49)
  Bottom Layer w0.165: -0.53,59.11 -1.59,60.17 -1.59,62.49 -0.31,63.77 16.89,63.77 17.79,64.67 17.79,68.24 18.62,69.08 22.34,69.08 22.92,68.49 38.04,68.49 38.71,67.82 v1(38.71,66.49)
$1N11096: length 52.4
  Bottom Layer w0.165: 40.09,68.07 39.4,68.76 23.03,68.76 22.45,69.34 18.51,69.34 17.52,68.36 17.52,64.78 16.78,64.04 -0.42,64.04 -1.86,62.61 -1.86,59.44 -0.53,58.11
$1N11098: length 74.1
  Top Layer w0.165: v1(58.77,66.97) 58.77,67.79 59.44,68.47 60.31,68.47
  Bottom Layer w0.165: v1(58.77,66.97) 58.77,67.59 57.33,69.03 23.14,69.03 22.56,69.61 4.77,69.61 -2.12,62.72 -2.12,58.7 -0.53,57.11
$1N11100: length 73.4
  Bottom Layer w0.165: -0.53,56.11 -2.39,57.97 -2.39,62.83 4.66,69.88 22.67,69.88 23.25,69.3 58.58,69.3 59.81,68.07
